# EasyEDA Pro project hardware.eprj, schematic Schematic7 (continued)
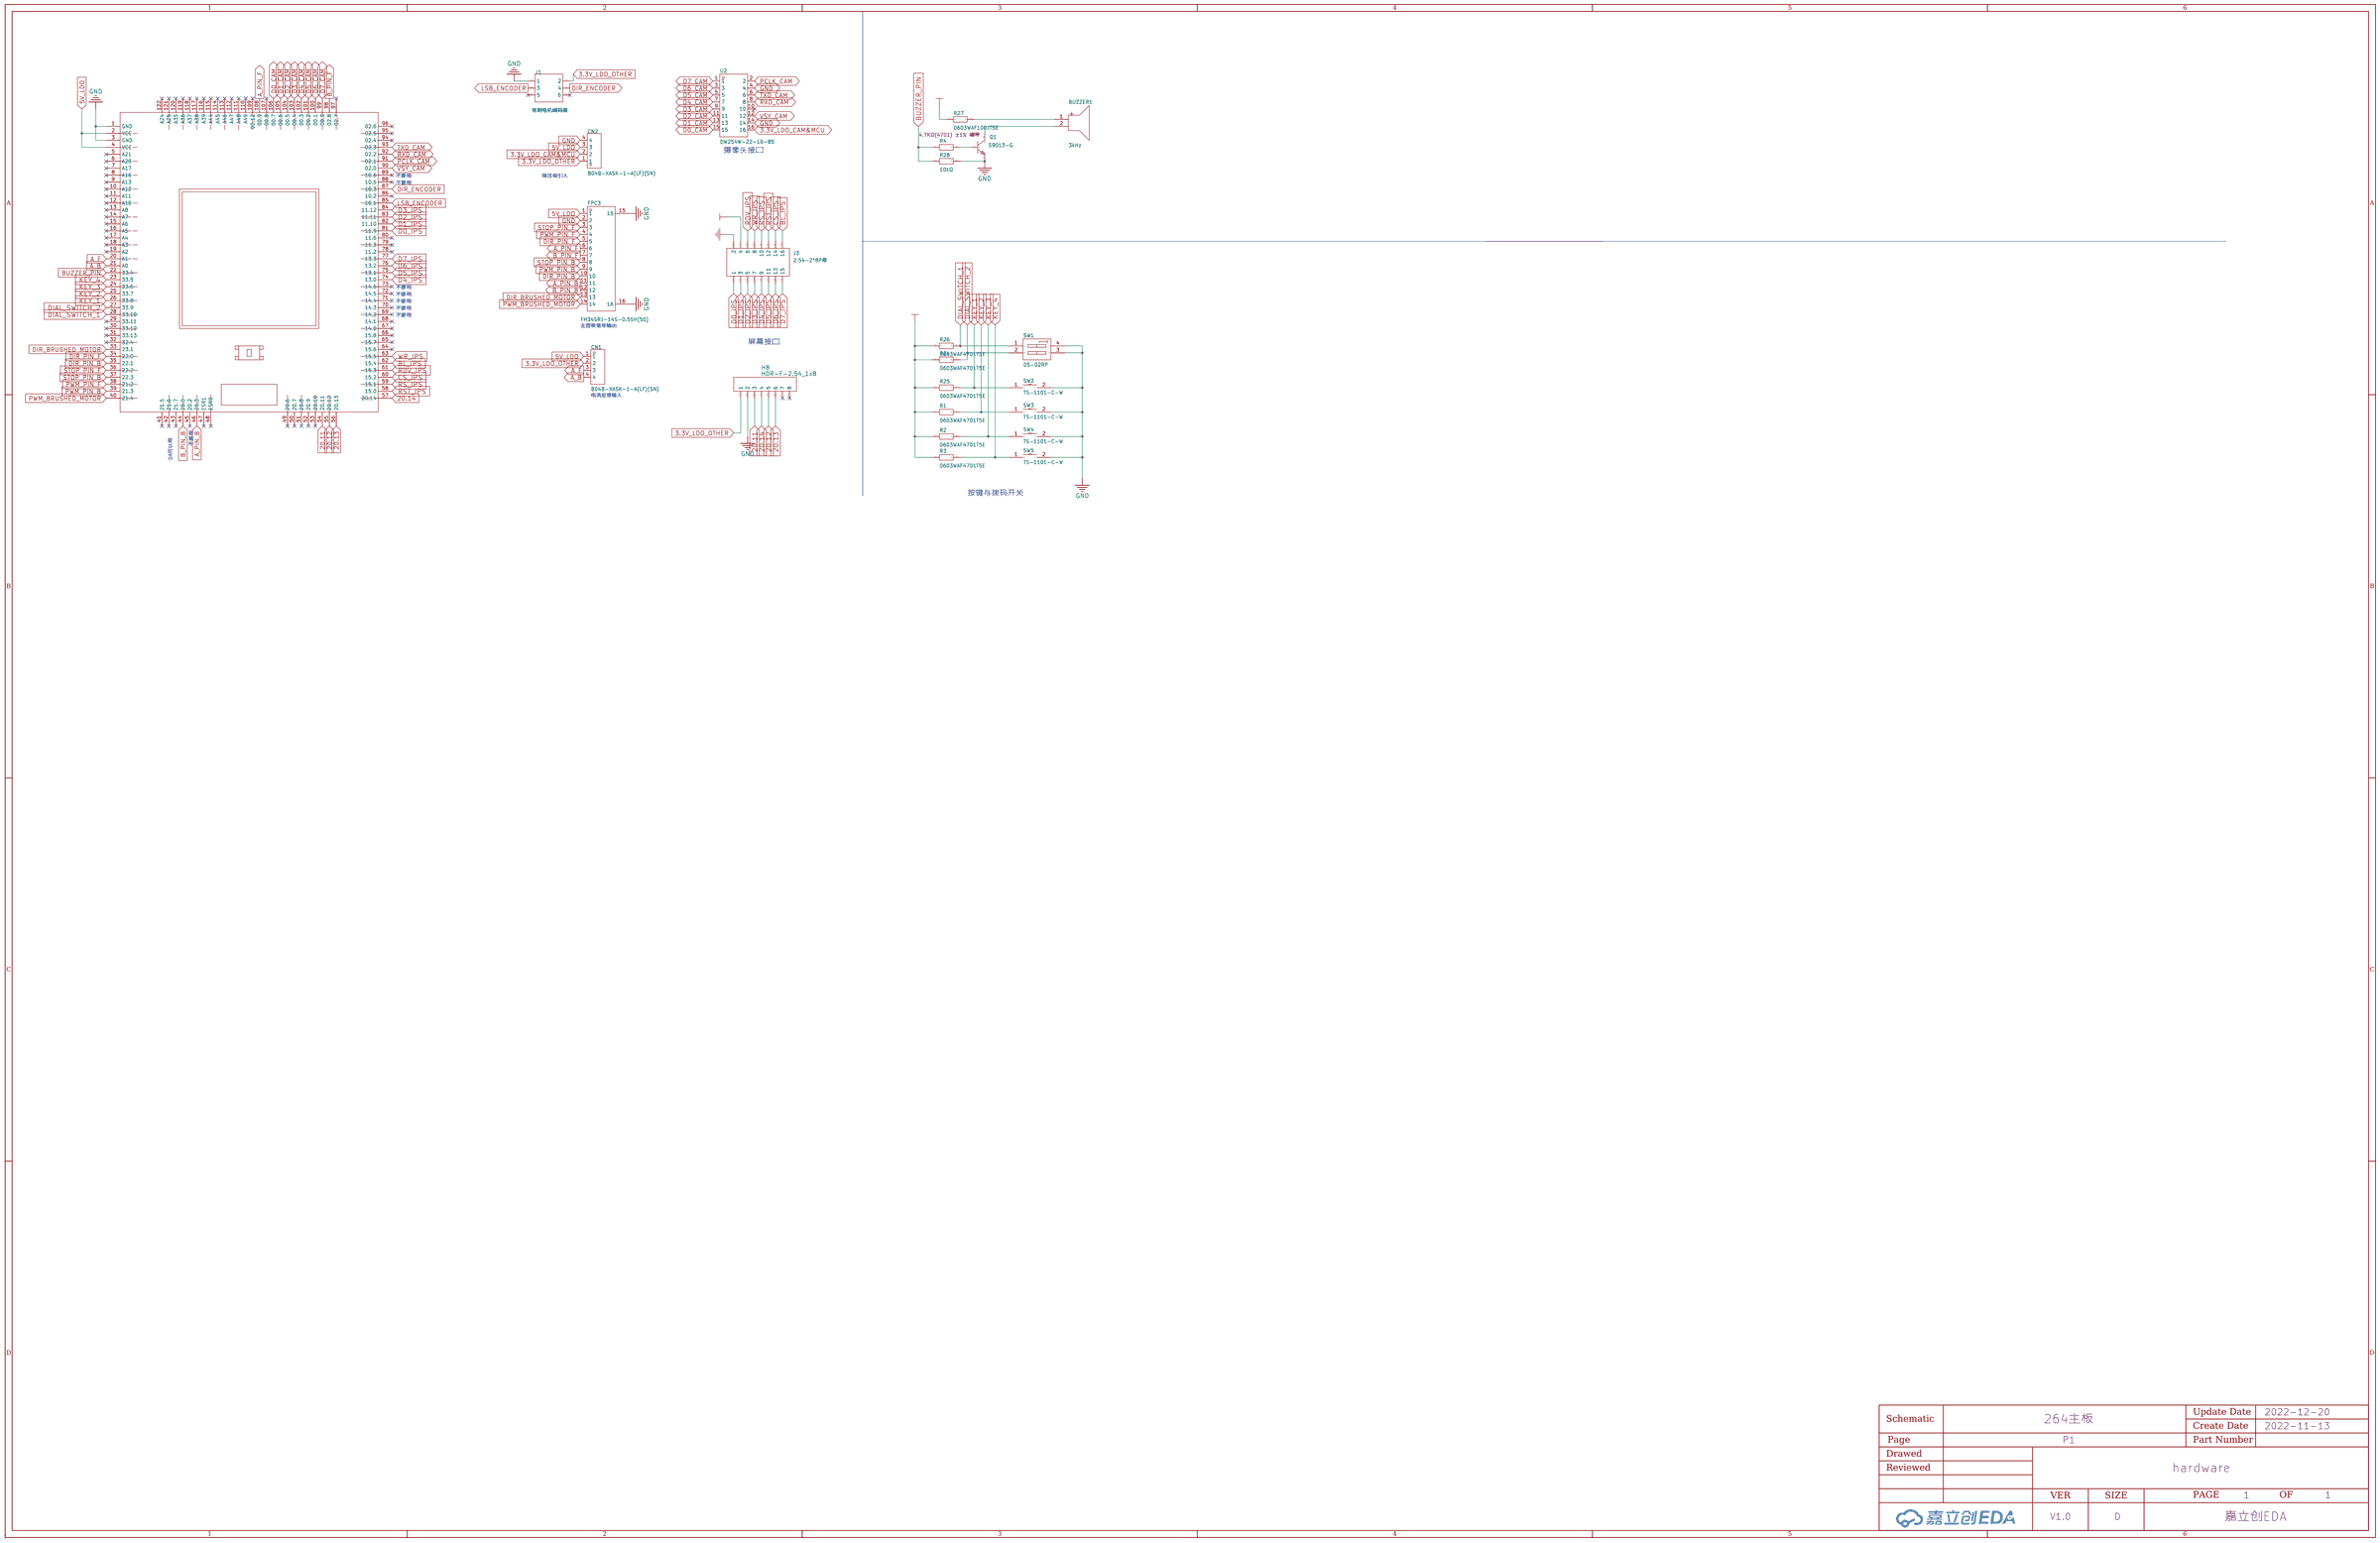
[diagram p0: schematic sheet]
## Library data of the parts (continued)
R12 R57 R59 R61 = 0603WAF1201T5E: LCSC Part Name: 1.2KΩ(1201) ±1% 编带; Supplier Part: C22765; Manufacturer: UNI-ROYAL(厚声); Supplier Footprint: 0603; JLCPCB Part Class: Basic Part; Datasheet: https://atta.szlcsc.com/upload/public/pdf/source/20170920/C22765_1505887453653980563.pdf; Supplier: LCSC
R13 = RC0603FR-07100RL: 电阻类型:厚膜电阻;阻值:100Ω;精度:±1%;功率:100mW;温度系数:±100ppm/℃;最大工作电压:75V;工作温度范围:-55℃~+155℃;; LCSC Part Name: 100Ω ±1%; Supplier Part: C105588; Manufacturer: YAGEO(国巨); Supplier Footprint: 0603; JLCPCB Part Class: Extended Part; Datasheet: https://atta.szlcsc.com/upload/public/pdf/source/20170428/1493376742308.pdf; Supplier: LCSC; Type: 厚膜电阻; Tolerance: ±1%; Power(Watts): 100mW; Temperature Coefficient: ±100ppm/℃; Overload Voltage (Max): 75V; Operating Temperature Range: -55℃~+155℃
R14-R17 R25 R62 = 0603WAF4701T5E: LCSC Part Name: 4.7KΩ(4701) ±1% 编带; Supplier Part: C23162; Manufacturer: UNI-ROYAL(厚声); Supplier Footprint: 0603; JLCPCB Part Class: Basic Part; Datasheet: https://atta.szlcsc.com/upload/public/pdf/source/20170920/C23162_1505901109673982545.pdf; Supplier: LCSC
R18 R28 R47 R48 R55 R58 R60 = 0603WAF1002T5E: 电阻类型:厚膜电阻;阻值:10kΩ;精度:±1%;功率:100mW;温度系数:±100ppm/;最大工作电压:75V;工作温度范围:-55~+155;; LCSC Part Name: 10kΩ ±1% 100mW; Supplier Part: C25804; Manufacturer: UNI-ROYAL(厚声); Supplier Footprint: 0603; JLCPCB Part Class: Basic Part; Datasheet: https://atta.szlcsc.com/upload/public/pdf/source/20200306/C422600_1E6D84923E4A46A82E41ADD87F860B5C.pdf; Supplier: LCSC; Type: 厚膜电阻; Tolerance: ±1%; Power(Watts): 100mW; Temperature Coefficient: ±100ppm/; Overload Voltage (Max): 75V; Operating Temperature Range: -55~+155
R27 = 0603WAF100JT5E: LCSC Part Name: 10Ω(10R0) ±1% 编带; Supplier Part: C22859; Manufacturer: UNI-ROYAL(厚声); Supplier Footprint: 0603; JLCPCB Part Class: Basic Part; Datasheet: https://atta.szlcsc.com/upload/public/pdf/source/20170920/C22859_1505900954295982249.pdf; Supplier: LCSC
SW1 = TS-1101-C-W: 触点电流:50mA;额定电压(DC):12V;绝缘电阻:100mΩ;电路结构:单刀单掷;安装方式:立贴;按钮形状:矩形按钮;按钮/盖帽颜色:白色;带灯:无;作用力:260gf;机械寿命:50000;工作温度:-30℃~+85℃;开关长度:6mm;开关宽度:3.6mm;开关高度:2.5mm;带支架:否;; LCSC Part Name: TS-1101-C-W 一型3*6*2.5有白ZD b拉伸白色按键 卷装; Supplier Part: C318938; Manufacturer: XKB Connectivity(中国星坤); Supplier Footprint: SMD; JLCPCB Part Class: Extended Part; Datasheet: https://atta.szlcsc.com/upload/public/pdf/source/20200227/C318938_C2E53B1EEDE37D980A33616AC086DE53.pdf; Supplier: LCSC; Contact Current: 50mA; Voltage Rating (DC): 12V; Insulation Resistance: 100mΩ; Circuit: 单刀单掷; Mounting Style: 立贴; Actuator Style: 矩形按钮; Actuator/Cap Color: 白色; With Lamp: 无; Operating Force: 260gf; Mechanical Life: 50000; Operating Temperature: -30℃~+85℃; Switch Length: 6mm; Switch Width: 3.6mm; Switch Height: 2.5mm; Strike Gundam: 否
SW2-SW5 = TS-1101-C-W: 触点电流:50mA;额定电压(DC):12V;绝缘电阻:100mΩ;电路结构:单刀单掷;安装方式:立贴;按钮形状:矩形按钮;按钮/盖帽颜色:白色;带灯:无;作用力:260gf;机械寿命:50000;工作温度:-30~+85;开关长度:6mm;开关宽度:3.6mm;开关高度:2.5mm;带支架:否;; LCSC Part Name: TS-1101-C-W 一型3*6*2.5有白ZD b拉伸白色按键 卷装; Supplier Part: C318938; Manufacturer: XKB Connectivity(中国星坤); Supplier Footprint: SMD; JLCPCB Part Class: Extended Part; Datasheet: https://atta.szlcsc.com/upload/public/pdf/source/20200227/C318938_C2E53B1EEDE37D980A33616AC086DE53.pdf; Supplier: LCSC; Contact Current: 50mA; Voltage Rating (DC): 12V; Insulation Resistance: 100mΩ; Circuit: 单刀单掷; Mounting Style: 立贴; Actuator Style: 矩形按钮; Actuator/Cap Color: 白色; With Lamp: 无; Operating Force: 260gf; Mechanical Life: 50000; Operating Temperature: -30~+85; Switch Length: 6mm; Switch Width: 3.6mm; Switch Height: 2.5mm; Strike Gundam: 否
U1 = TC377TP96F300SAAKXUMA1: Supplier Part: C3232089; Manufacturer: Infineon(英飞凌); Supplier Footprint: PG-LFBGA-292-6; Datasheet: https://atta.szlcsc.comnull; Supplier: LCSC
U2 U3 = CBM160808U501T: 标称阻抗@测试频率:500Ω@100MHz;误差:±25%;直流电阻(RDC):180mΩ;额定电流:1.2A;电路数:1;; LCSC Part Name: 500Ω@100MHz ±25%; Supplier Part: C316451; Manufacturer: FH(风华); Supplier Footprint: 0603; JLCPCB Part Class: Extended Part; Datasheet: https://atta.szlcsc.com/upload/public/pdf/source/20181211/C316451_DBF3079B2B53D5C89DC535D7CFA82CCE.pdf; Supplier: LCSC; Impedance @ Frequency: 500Ω@100MHz; Tolerance: ±25%; DC Resistance: 180mΩ; Current Rating: 1.2A; Circuits: 1
U4 U20-U22 = RT9043GB: 输出类型:可调;输出极性:正;输出通道数:1;最大输入电压:5.5V;输出电压:1.2V~5V;压差:350mV@(400mA);输出电流:400mA;电源纹波抑制比(PRSS):67dB@(1kHz),56dB@(10kHz);; LCSC Part Name: Vin=5.5V Vout=1.2V~5V 400mA 67dB@(1kHz),56dB@(10kHz); Supplier Part: C55019; Manufacturer: RICHTEK(台湾立锜); Supplier Footprint: SOT-23-5; JLCPCB Part Class: Extended Part; Datasheet: https://atta.szlcsc.com/upload/public/pdf/source/20150811/1457707342352.pdf; Supplier: LCSC; Output Type: 可调; Output Polarity: 正; Number of Outputs: 1; Maximum Input Voltage: 5.5V; Output Voltage: 1.2V~5V; Dropout Voltage: 350mV@(400mA); Output Current: 400mA; Power Supply Rejection Ratio (PRSS): 67dB@(1kHz),56dB@(10kHz)
U6 = PM254-1-08-W-8.5: 间距:2.54mm;总孔位数:8;排数:1;插孔结构:1x8P;行距:-;安装类型:弯插;圆孔/方孔:方孔;额定电流:3A;额定电压:-;插孔方向:侧面;塑高:8.5mm;工作温度范围:-40℃~+105℃;; LCSC Part Name: 2.54mm 1x8P; Supplier Part: C2897390; Manufacturer: HCTL(华灿天禄); Supplier Footprint: 弯插,P=2.54mm; JLCPCB Part Class: Extended Part; Datasheet: https://atta.szlcsc.com/upload/public/pdf/source/20211019/10E5F374A8C70BEE256048F5DCDE14A3.pdf; Supplier: LCSC; Pitch: 2.54mm; Number of Holes: 8; Number of Rows: 1; Holes Structure: 1x8P; Mounting Type: 弯插; Circular Hole / Square Hole: 方孔; Current Rating (Max): 3A; Holes Direction: 侧面; Insulation Height: 8.5mm; Operating Temperature Range: -40℃~+105℃
X1 = X322520MSB4SI: 晶振类型:贴片无源晶振;频率:20MHz;频率公差:±10ppm;频率稳定度:±30ppm;负载电容:20pF;工作温度:-40℃~+85℃;; LCSC Part Name: YSX321SL 20MHz ±10ppm 20pF; Supplier Part: C9004; Manufacturer: YXC(扬兴晶振); Supplier Footprint: SMD3225-4P; JLCPCB Part Class: Extended Part; Datasheet: https://atta.szlcsc.com/upload/public/pdf/source/20210329/C112971_1F611BDC486E193C1706F6D8EB5AA189.pdf; Supplier: LCSC; Crystal Type: 贴片无源晶振; Frequency Tolerance: ±10ppm; Frequency Stability: ±30ppm; Load Capacitance: 20pF; Operating Temperature: -40℃~+85℃
C56 C65 C66 = CL31A106KBHNNNE: 容值:10uF;精度:±10%;额定电压:50V;材质(温度系数):X5R;; LCSC Part Name: 10uF ±10% 50V; Supplier Part: C13585; Manufacturer: SAMSUNG(三星); Supplier Footprint: 1206; JLCPCB Part Class: Basic Part; Datasheet: https://atta.szlcsc.com/upload/public/pdf/source/20160103/1457707668742.pdf; Supplier: LCSC; Tolerance: ±10%; Voltage Rated: 50V; Temperature Coefficient: X5R
C57 C59 C70 = CC0603KRX7R9BB104: 容值:100nF;精度:±10%;额定电压:50V;材质(温度系数):X7R;; LCSC Part Name: 100nF ±10% 50V; Supplier Part: C14663; Manufacturer: YAGEO(国巨); Supplier Footprint: 0603; JLCPCB Part Class: Basic Part; Datasheet: https://atta.szlcsc.com/upload/public/pdf/source/20170116/1484561234239.pdf; Supplier: LCSC; Tolerance: ±10%; Voltage Rated: 50V; Temperature Coefficient: X7R
C58 C60 C61 = CL10A105KB8NNNC: 温度系数:X5R;精度:±10%;额定电压:50V;容值:1uF;; LCSC Part Name: 1uF(105) ±10% 50V; Supplier Part: C15849; Manufacturer: SAMSUNG(三星); Supplier Footprint: 0603; JLCPCB Part Class: Basic Part; Datasheet: https://atta.szlcsc.com/upload/public/pdf/source/20160103/1457707679084.pdf; Supplier: LCSC; Temperature Coefficient: X5R; Tolerance: ±10%; Voltage Rated: 50V
C62 = KM227M050G13RR0VH2FP0: 容值:220uF;脚间距:5mm;纹波电流:-;额定电压:50V;等效串联电阻:-;精度:±20%;工作寿命:2000hrs 105;电容体直径:10mm;工作温度:-;电容体长度:13mm;; LCSC Part Name: 220uF 50V; Supplier Part: C45105; Manufacturer: CX(承兴); Supplier Footprint: 径向引线,10x13mm; JLCPCB Part Class: Extended Part; Datasheet: https://atta.szlcsc.com/upload/public/pdf/source/20151029/1457707529682.pdf; Supplier: LCSC; Lead Spacing: 5mm; Rated Voltage: 50V; Tolerance: ±20%; Lifetime @ Temp: 2000hrs 105; φD: 10mm; L: 13mm
C67 = CC0603KRX7R9BB822: 容值:8.2nF;精度:±10%;额定电压:50V;材质(温度系数):X7R;; LCSC Part Name: 8.2nF ±10% 50V; Supplier Part: C113812; Manufacturer: YAGEO(国巨); Supplier Footprint: 0603; JLCPCB Part Class: Extended Part; Datasheet: https://atta.szlcsc.com/upload/public/pdf/source/20170602/1496384445452.pdf; Supplier: LCSC; Tolerance: ±10%; Voltage Rated: 50V; Temperature Coefficient: X7R
C68 = CC0402JRNPO9BN100: 容值:10pF;精度:±5%;额定电压:50V;材质(温度系数):NP0;; LCSC Part Name: 10pF ±5% 50V; Supplier Part: C106199; Manufacturer: YAGEO(国巨); Supplier Footprint: 0402; JLCPCB Part Class: Extended Part; Datasheet: https://atta.szlcsc.com/upload/public/pdf/source/20170518/1495085708228.pdf; Supplier: LCSC; Tolerance: ±5%; Voltage Rated: 50V; Temperature Coefficient: NP0
C69 = CC0603KRX7R9BB102: 容值:1nF;精度:±10%;额定电压:50V;材质(温度系数):X7R;; LCSC Part Name: 1nF ±10% 50V; Supplier Part: C100040; Manufacturer: YAGEO(国巨); Supplier Footprint: 0603; JLCPCB Part Class: Extended Part; Datasheet: https://atta.szlcsc.com/upload/public/pdf/source/20170420/1492670664651.pdf; Supplier: LCSC; Tolerance: ±10%; Voltage Rated: 50V; Temperature Coefficient: X7R
C71 C72 = GRM31CR61A476ME15L: 容值:47uF;精度:±20%;额定电压:10V;温度系数:X5R;; LCSC Part Name: 47uF 10V; Supplier Part: C94034; Manufacturer: muRata(村田); Supplier Footprint: 1206; JLCPCB Part Class: Extended Part; Datasheet: https://atta.szlcsc.com/upload/public/pdf/source/20170310/1489116302849.pdf; Supplier: LCSC; Tolerance: ±20%; Voltage Rated: 10V; Temperature Coefficient: X5R
C80 = CC0603KRX7R9BB103: 容值:10nF;精度:±10%;额定电压:50V;材质(温度系数):X7R;; LCSC Part Name: 10nF ±10% 50V; Supplier Part: C100042; Manufacturer: YAGEO(国巨); Supplier Footprint: 0603; JLCPCB Part Class: Extended Part; Datasheet: https://atta.szlcsc.com/upload/public/pdf/source/20180326/C100042_E8B0111D51DE3671A0A4A59FBCEFE81C.pdf; Supplier: LCSC; Tolerance: ±10%; Voltage Rated: 50V; Temperature Coefficient: X7R
CN2 = XT60PW-M: 模型锂电连接器; LCSC Part Name: XT60PW 公头 板插卧式; Supplier Part: C98732; Manufacturer: AMASS(艾迈斯); Supplier Footprint: Through Hole; JLCPCB Part Class: Extended Part; Datasheet: https://atta.szlcsc.com/upload/public/pdf/source/20180125/C98732_15168617837851301983.pdf; Supplier: LCSC
CN7 = XT30PW-M: Socket,DCsupply,XT30,male,PIN:2; LCSC Part Name: XT30PW-M公头; Supplier Part: C431092; Manufacturer: AMASS(艾迈斯); Supplier Footprint: Through Hole; JLCPCB Part Class: Extended Part; Datasheet: https://atta.szlcsc.com/upload/public/pdf/source/20220222/6A9F22F7850E25B33E1BE430ADF8560B.pdf; Supplier: LCSC
CN8 CN9 = HC-ZH1.5-8AW: 参考系列:ZH;间距:1.5mm;插针结构:1x8P;排数:1;每排PIN数:8;行距:-;公母:公型插针;安装方式:弯插;额定电流:1A;工作温度范围:-25~+85;; LCSC Part Name: 8P 间距P=1.5mm; Supplier Part: C2845571; Manufacturer: HCTL(华灿天禄); Supplier Footprint: 插件,P=1.5mm; JLCPCB Part Class: Extended Part; Datasheet: https://atta.szlcsc.com/upload/public/pdf/source/20211122/624702E7E83328BF37B6C704FA01E49F.pdf; Supplier: LCSC; Reference Series: ZH; Pitch: 1.5mm; Pins Structure: 1x8P; Number of Rows: 1; Number of PINs Per Row: 8; Gender: 公型插针; Mounting Style: 弯插; Current Rating (Max): 1A; Operating Temperature Range: -25~+85
D2 = SS34_C8678: 40V,3A,VF=0.55V 3A; Supplier Part: C8678; Manufacturer: MDD; Supplier Footprint: SMA(DO-214AC); JLCPCB Part Class: Basic Part; Datasheet: https://atta.szlcsc.com/upload/public/pdf/source/20220408/D0396E57A6E83C6AFC0ED25EC9EDE030.pdf; Supplier: LCSC
D3 = SS54C_C908244: 二极管配置:独立式;直流反向耐压(Vr):40V;平均整流电流(Io):5A;正向压降(Vf):550mV@5A;反向电流(Ir):500uA@40V;; LCSC Part Name: 40V 5A 550mV@5A; Supplier Part: C908244; Manufacturer: FUXINSEMI(富芯森美); Supplier Footprint: SMC(DO-214AB); JLCPCB Part Class: Extended Part; Datasheet: https://atta.szlcsc.com/upload/public/pdf/source/20201027/C908242_77C8A81B3EBE52B4332ED1F80CC85D97.pdf; Supplier: LCSC; Diode Configuration: 独立式; Reverse Voltage (Vr): 40V; Average Rectified Current (Io): 5A; Forward Voltage (Vf@If): 550mV@5A; Reverse Leakage Current (Ir): 500uA@40V
L3 = MWSA1004S-100MT: 精度:±20%;直流电阻(DCR):30mΩ;额定电流:7.8A;电感值:10uH;; LCSC Part Name: 10uH ±20%; Supplier Part: C408487; Manufacturer: Sunlord(顺络); Supplier Footprint: SMD; JLCPCB Part Class: Extended Part; Datasheet: https://atta.szlcsc.com/upload/public/pdf/source/20190729/C408487_10B27C975B2F63C7424A4B34DD502902.pdf; Supplier: LCSC; Tolerance: ±20%; DC Resistance (DCR): 30mΩ; Height: 4mm; Rated Current: 7.8A; Width: 11.5mm; Length: 10mm
LED9-LED11 = 19-217/GHC-YR1S2/3T: 照明颜色:翠绿;色温 - CCT（K）:-;主波长/色坐标:520~535nm;; LCSC Part Name: 翠绿LED; Supplier Part: C72043; Manufacturer: EVERLIGHT(台湾亿光); Supplier Footprint: 0603; JLCPCB Part Class: Basic Part; Datasheet: https://atta.szlcsc.com/upload/public/pdf/source/20160507/1462613613780.pdf; Supplier: LCSC; Mounting Type: 表面贴装; Illumination Color: 翠绿; Luminous Intensity (IF=20mA): 112~258mcd; Dominant Wavelength / Coordinate rank: 520~535nm
Q7-Q10 = TPH1R403NL,L1Q(M: Supplier Part: C2940403; Manufacturer: TOSHIBA(东芝); Supplier Footprint: SOP-8; Datasheet: https://atta.szlcsc.com/upload/public/pdf/source/20220830/C277A7BCA37DB7348B2C95BA2E6DA6BE.pdf; Supplier: LCSC
R11 R19-R21 R46 = 0603WAF0000T5E: 温度系数:-;精度:±1%;阻值:0Ω;功率:1/10W;最大工作电压:75V;工作温度范围:-55~+155;; LCSC Part Name: 0Ω ±1%; Supplier Part: C21189; Manufacturer: UNI-ROYAL(厚声); Supplier Footprint: 0603; JLCPCB Part Class: Basic Part; Datasheet: https://atta.szlcsc.com/upload/public/pdf/source/20170920/C21189_1505887441435980537.pdf; Supplier: LCSC; Tolerance: ±1%; Power(Watts): 1/10W; Overload Voltage (Max): 75V; Operating Temperature Range: -55~+155
R52 = 0603WAF6812T5E: LCSC Part Name: 68.1KΩ(6812) ±1% 编带; Supplier Part: C25976; Manufacturer: UNI-ROYAL(厚声); Supplier Footprint: 0603; JLCPCB Part Class: Extended Part; Datasheet: https://atta.szlcsc.com/upload/public/pdf/source/20170920/C25976_1505895134985980970.pdf; Supplier: LCSC
R53 = 0603WAF1022T5E: 电阻类型:厚膜电阻;阻值:10.2kΩ;精度:±1%;功率:100mW;温度系数:±100ppm/;最大工作电压:75V;工作温度范围:-55~+155;; LCSC Part Name: 10.2kΩ ±1% 100mW; Supplier Part: C22772; Manufacturer: UNI-ROYAL(厚声); Supplier Footprint: 0603; JLCPCB Part Class: Extended Part; Datasheet: https://atta.szlcsc.com/upload/public/pdf/source/20200306/C422600_1E6D84923E4A46A82E41ADD87F860B5C.pdf; Supplier: LCSC; Type: 厚膜电阻; Tolerance: ±1%; Power(Watts): 100mW; Temperature Coefficient: ±100ppm/; Overload Voltage (Max): 75V; Operating Temperature Range: -55~+155
R54 = 0603WAF1741T5E: 电阻类型:厚膜电阻;阻值:1.74kΩ;精度:±1%;功率:1/10W;温度系数:±100ppm/;最大工作电压:75V;工作温度范围:-55~+155;; LCSC Part Name: 1.74kΩ ±1%; Supplier Part: C22848; Manufacturer: UNI-ROYAL(厚声); Supplier Footprint: 0603; JLCPCB Part Class: Extended Part; Datasheet: https://atta.szlcsc.com/upload/public/pdf/source/20200306/C422600_1E6D84923E4A46A82E41ADD87F860B5C.pdf; Supplier: LCSC; Type: 厚膜电阻; Tolerance: ±1%; Power(Watts): 1/10W; Temperature Coefficient: ±100ppm/; Overload Voltage (Max): 75V; Operating Temperature Range: -55~+155
R56 = 0603WAF3831T5E: 精度:±1%;温度系数:±100ppm/;功率:1/10W;阻值:3.83kΩ;最大工作电压:75V;工作温度范围:-55~+155;; LCSC Part Name: 3.83KΩ ±1%; Supplier Part: C22982; Manufacturer: UNI-ROYAL(厚声); Supplier Footprint: 0603; JLCPCB Part Class: Extended Part; Datasheet: https://atta.szlcsc.com/upload/public/pdf/source/20170920/C22982_1505901016435982369.pdf; Supplier: LCSC; Tolerance: ±1%; Temperature Coefficient: ±100ppm/; Power(Watts): 1/10W; Overload Voltage (Max): 75V; Operating Temperature Range: -55~+155
R63 R64 = 0603WAF2701T5E: 电阻类型:厚膜电阻;阻值:2.7kΩ;精度:±1%;功率:100mW;温度系数:±100ppm/;最大工作电压:75V;工作温度范围:-55~+155;; LCSC Part Name: 2.7kΩ ±1% 100mW; Supplier Part: C13167; Manufacturer: UNI-ROYAL(厚声); Supplier Footprint: 0603; JLCPCB Part Class: Basic Part; Datasheet: https://atta.szlcsc.com/upload/public/pdf/source/20200306/C422600_1E6D84923E4A46A82E41ADD87F860B5C.pdf; Supplier: LCSC; Type: 厚膜电阻; Tolerance: ±1%; Power(Watts): 100mW; Temperature Coefficient: ±100ppm/; Overload Voltage (Max): 75V; Operating Temperature Range: -55~+155
R65 R66 = 0603WAF2101T5E: 电阻类型:厚膜电阻;阻值:2.1kΩ;精度:±1%;功率:100mW;温度系数:±100ppm/;最大工作电压:75V;工作温度范围:-55~+155;; LCSC Part Name: 2.1kΩ ±1% 100mW; Supplier Part: C22902; Manufacturer: UNI-ROYAL(厚声); Supplier Footprint: 0603; JLCPCB Part Class: Extended Part; Datasheet: https://atta.szlcsc.com/upload/public/pdf/source/20200306/C422600_1E6D84923E4A46A82E41ADD87F860B5C.pdf; Supplier: LCSC; Type: 厚膜电阻; Tolerance: ±1%; Power(Watts): 100mW; Temperature Coefficient: ±100ppm/; Overload Voltage (Max): 75V; Operating Temperature Range: -55~+155
SW8 = MT-0-103-A101-M200-RS+PJ: 额定电流:5A;额定电压(AC):125V;电路结构:单刀双掷;钮柄形状:圆柱钮柄;引脚样式:焊片;安装方式:直插;工作温度:-25~+85;开关长度:13mm;开关宽度:8mm;开关高度:28.6mm;; LCSC Part Name: 小型钮子三脚三档(五件套); Supplier Part: C1788493; Manufacturer: YUEN FUNG(源丰); Supplier Footprint: 插件; JLCPCB Part Class: Extended Part; Datasheet: https://atta.szlcsc.com/upload/public/pdf/source/20201225/C1788493_608759AD4D4A20FF90A03E3E3321FD91.pdf; Supplier: LCSC; Contact Current: 5A; Voltage Rating (AC): 125V; Circuit: 单刀双掷; Actuator Type: 圆柱钮柄; Pin Style: 焊片; Mounting Style: 直插; Operating Temperature: -25~+85; Switch Length: 13mm; Switch Width: 8mm; Switch Height: 28.6mm
U7 U24 = CC6902SO-5A: 单芯片霍尔电流传感器5A/10A/20A/30A系列,隔离耐压2kV,增益400mV/A; Supplier Part: C465515; Manufacturer: CrossChip(成都芯进); Supplier Footprint: SOP-8-150mil; JLCPCB Part Class: Extended Part; Datasheet: https://atta.szlcsc.com/upload/public/pdf/source/20210401/C350865_A3325EEAFF04FA6E122338C4D9E855FE.pdf; Supplier: LCSC
U16 = DRV8701ERGET: DRV8701 DRV8701 H 桥栅极驱动器; Supplier Part: C132049; Manufacturer: TI(德州仪器); Supplier Footprint: VQFN-24; JLCPCB Part Class: Extended Part; Datasheet: https://atta.szlcsc.com/upload/public/pdf/source/20170925/C132049_1506321643935990409.pdf; Supplier: LCSC
U17 = SN74HC125PWR: 逻辑电路的归属系列:74HC;逻辑类型:缓冲器，非反向;元件数:4;每元件位数:1;; Supplier Part: C132994; Manufacturer: TI(德州仪器); Supplier Footprint: TSSOP-14; JLCPCB Part Class: Extended Part; Datasheet: https://atta.szlcsc.com/upload/public/pdf/source/20170930/C132994_1506736365150997346.pdf; Supplier: LCSC; Series: 74HC; Logic Type: 缓冲器，非反向; Number of Elements: 4; Number of Bits per Element: 1; Output Type: 三态; Current - Output High, Low: 7.8mA、7.8mA; Voltage - Supply: 2V ~ 6V; Operating Temperature: -40~+85（TA）
U19 = TPS54331DDAR: 功能类型:降压型;同步整流:-;输出通道数:-;拓扑结构:-;输入电压:-;输出电流(最大值):-;开关频率:-;; LCSC Part Name: 降压型; Supplier Part: C90761; Manufacturer: TI(德州仪器); Supplier Footprint: SOIC-8-EP-150mil; JLCPCB Part Class: Extended Part; Datasheet: https://atta.szlcsc.com/upload/public/pdf/source/20171221/C90761_15138313277351195613.pdf; Supplier: LCSC; Function: 降压型

## Nets
1.3V: C1.2 C2.2 C3.2 C4.2 C5.2 C6.2 C7.2 C8.2 C20.2 C21.2 C22.2 C27.1 C81.2 R13.2 U1.D16(VDD) U1.E15(VDD) U1.G8(VDDSB(VDD)) U1.G13(VDD) U1.H7(VDDSB(VDD)) U1.H14(VDD) U1.N7(VDD) U1.N14(VDD) U1.N19(VDD) U1.P8(VDD) U1.P13(VDD) U4.5(VOUT)
3.3V_LDO_CAM&MCU: C10.2 C11.2 C12.2 C13.2 C14.2 C15.2 C16.2 C17.2 C18.2 C19.2 C28.1 C75.1 FPC1.17 FPC1.18 R6.1 R18.1 R63.2 R66.2 U1.A2(VEXT) U1.A19(VDDP3) U1.B3(VEXT) U1.B18(VDDP3) U1.D5(VFLEX) U1.N20(VEXT) U1.T11(VEVRSB) U1.V19(VFLEX2) U1.W20(VEXT) U4.1(VIN) U21.5(VOUT)
3.3V_LDO_OTHER: C77.1 H1.1 J1.2 J3.4 LED2.2(A) LED3.2(A) Q1.2(E) R1.2 R14.1 R15.1 R16.1 R25.1 R27.1 R64.2 R65.2 U6.1 U7.8(VCC) U16.13(nSLEEP) U22.5(VOUT) U24.8(VCC)
5.5V_DCDC: C71.2 C72.2 C74.1 C76.1 C78.1 L3.2 R53.2 R55.1 R58.1 R60.1 U20.1(VIN) U21.1(VIN) U22.1(VIN)
5V_LDO: C73.1 CN8.6 CN9.6 H3.7 R56.2 R62.2 U2.1 U20.5(VOUT)
DVDD: C61.2 U16.8(DVDD) U17.14(VCC)
GND: C56.1 C57.2 C60.1 C61.1 C62.2 C65.1 C66.1 C67.1 C68.1 C69.1 C71.1 C72.1 C73.2 C74.2 C75.2 C76.2 C77.2 C78.2 C80.1 CN2.1(-) CN8.2 CN9.2 D3.1(A) LED9.2(C) LED10.2(C) LED11.2(C) R11.2 R19.2 R20.2 R21.2 R46.1 R47.1 R48.1 R54.1 R57.1 R59.1 R61.1 U7.5(GND) U16.5(GND) U16.16(GND) U16.25(EP) U17.1(1OE#) U17.4(2OE#) U17.7(GND) U17.10(3OE#) U17.13(4OE#) U19.7(GND) U19.9(EP) U20.2(GND) U21.2(GND) U22.2(GND) U24.5(GND)
GND_CORE: C1.1 C2.1 C3.1 C4.1 C5.1 C6.1 C7.1 C8.1 C10.1 C11.1 C12.1 C13.1 C14.1 C15.1 C16.1 C17.1 C18.1 C19.1 C20.1 C21.1 C22.1 C23.1 C27.2 C28.2 C81.1 FPC1.2 FPC1.7 FPC1.16 FPC1.19 FPC1.20 H1.3 H1.5 H3.5 H3.6 J1.1 J3.2 Q2.2(E) R3.2 R11.1 R12.1 R19.1 R20.1 R21.1 R28.2 SW1.1 SW2.2 SW3.2 SW4.2 SW5.2 U1.A20(VSS) U1.B2(VSS) U1.B19(VSS) U1.D4(VSS) U1.D17(VSS) U1.E5(VSS) U1.E16(VSS) U1.G9(VSS) U1.G12(VSS) U1.H9(VSS) U1.H10(VSS) U1.H11(VSS) U1.H12(VSS) U1.J7(VSS) U1.J8(VSS) U1.J10(VSS) U1.J11(VSS) U1.J13(VSS) U1.J14(VSS) U1.K7(AGBTCLKP(VSS)) U1.K8(VSS) U1.K9(VSS) U1.K10(VSS) U1.K11(VSS) U1.K12(VSS) U1.K13(VSS) U1.L7(AGBTCLKN(VSS)) U1.L8(VSS) U1.L9(VSS) U1.L10(VSS) U1.L11(VSS) U1.L12(VSS) U1.L13(VSS) U1.L14(AGBTERR(VSS)) U1.L20(VSS) U1.M7(VSS) U1.M8(VSS) U1.M10(VSS) U1.M11(VSS) U1.M13(VSS) U1.M14(VSS) U1.N9(VSS) U1.N10(VSS) U1.N11(VSS) U1.N12(VSS) U1.P9(VSS) U1.P10(AGBTTXN(VSS)) U1.P11(AGBTTXP(VSS)) U1.P12(VSS) U1.T16(VSS) U1.U17(VSS) U1.W19(VSS) U1.Y20(VSS) U3.2 U4.2(GND) U6.2 X1.2(GND) X1.4(GND)
VCC_BAT: C62.1 C65.2 C66.2 C80.2 D2.2(A) Q7.5(D) Q7.6(D) Q7.7(D) Q7.8(D) Q7.9(D) Q9.5(D) Q9.6(D) Q9.7(D) Q9.8(D) Q9.9(D) SW8.2 SW8.3 U7.1(IP+) U7.2(IP+) U19.2(VIN) U24.1(IP+) U24.2(IP+)
VCC_BAT_B: CN9.1 U24.3(IP-) U24.4(IP-)
VCC_BAT_F: CN8.1 U7.3(IP-) U7.4(IP-)
VDDM: C26.2 R7.2 R8.2
VSSM: C26.1 R9.2 R10.2
10.2: H3.4 U1.A5(P10.2)
10.5: H3.1 U1.B5(P10.5)
10.6: H3.3 U1.A4(P10.6)
A_B: U1.U10(AN1) U24.7(OUT)
A_BRUSHED_MOTOR: CN7.2 Q7.1(S) Q7.2(S) Q7.3(S) Q8.5(D) Q8.6(D) Q8.7(D) Q8.8(D) Q8.9(D) U16.23(SH2)
A_F: U1.T10(AN0) U7.7(OUT)
A_PIN_B: CN9.7 U1.G20(P20.3)
A_PIN_F: CN8.7 U1.K2(P00.9)
B_BRUSHED_MOTOR: CN7.1 Q9.1(S) Q9.2(S) Q9.3(S) Q10.5(D) Q10.6(D) Q10.7(D) Q10.8(D) Q10.9(D) U16.18(SH1)
B_PIN_B: CN9.8 U1.H20(P20.0)
B_PIN_F: CN8.8 U1.F1(P02.8)
BL_IPS: J3.16 U1.A17(P15.4)
BUZZER_PIN: R17.1 R28.1 U1.W12(P33.4)
CS_IMU: U1.D20(P20.13) U6.6
CS_IPS: J3.14 U1.C19(P15.2)
D0_CAM: FPC1.8 U1.K1(P00.7)
D0_IPS: J3.1 U1.A9(P11.9)
D1_CAM: FPC1.9 U1.J4(P00.6)
D1_IPS: J3.3 U1.B9(P11.10)
D2_CAM: FPC1.10 U1.J2(P00.5)
D2_IPS: J3.5 U1.A8(P11.11)
D3_CAM: FPC1.11 U1.J1(P00.4)
D3_IPS: J3.7 U1.B8(P11.12)
D4_CAM: FPC1.12 U1.H2(P00.3)
D4_IPS: J3.9 U1.B12(P13.0)
D5_CAM: FPC1.13 U1.H1(P00.2)
D5_IPS: J3.11 U1.A12(P13.1)
D6_CAM: FPC1.14 U1.G2(P00.1)
D6_IPS: J3.13 U1.B11(P13.2)
D7_CAM: FPC1.15 U1.G1(P00.0)
D7_IPS: J3.15 U1.A11(P13.3)
DIR_BRUSHED_MOTOR: R47.2 U1.U19(P23.1) U17.2(1A)
DIR_BRUSHED_MOTOR_OK: U16.15(PH) U17.3(1Y)
DIR_ENCODER: J1.4 U1.B7(P10.1)
DIR_PIN_B: CN9.5 U1.L17(P22.1)
DIR_PIN_F: CN8.5 U1.L16(P22.0)
KEY_1: R25.2 SW2.1 U1.W14(P33.8)
KEY_2: R14.2 SW3.1 U1.Y13(P33.7)
KEY_3: R15.2 SW4.1 U1.W13(P33.6)
KEY_4: R16.2 SW5.1 U1.Y12(P33.5)
LSB_ENCODER: J1.3 U1.A6(P10.3)
P02.5: R5.2 U1.E2(P02.5)
P02.6: R4.2 U1.E1(P02.6)
P14.0: H1.7 U1.B16(P14.0)
P14.1: H1.9 U1.A15(P14.1)
P21.7: H1.6 U1.H16(P21.7/TDO)
PCLK_CAM: FPC1.1 U1.C2(P02.1)
PWM_BRUSHED_MOTOR: R48.2 U1.K20(P21.4) U17.5(2A)
PWM_BRUSHED_MOTOR_OK: U16.14(EN) U17.6(2Y)
PWM_PIN_B: CN9.4 U1.J19(P21.3)
PWM_PIN_F: CN8.4 U1.K19(P21.2)
RDV_IPS: J3.6 U1.B17(P15.3)
RS_IPS: J3.10 U1.A18(P15.1)
RST: F1.2 H1.10 U1.G17(PORST#)
RST_IPS: J3.12 U1.B20(P15.0)
RXD_CAM: FPC1.4 U1.C1(P02.2)
SDI_IMU: U1.C20(P20.14) U6.4
SDO_IMU: U1.D19(P20.12) U6.5
SPC_IMU: U1.E20(P20.11) U6.3
STOP_PIN_B: CN9.3 U1.R19(P22.3)
STOP_PIN_F: CN8.3 U1.R20(P22.2)
TCK: H1.4 U1.J16(TCK)
TMS: H1.2 U1.K16(TMS)
TRST: H1.8 R6.2 U1.L19(TRST#)
TXD_CAM: FPC1.3 U1.D2(P02.3)
VAGND1: C25.1 R10.1 U1.Y7(VAGND1)
VAGND2: C24.1 R9.1 U1.T2(VAGND2)
VAREF1: C25.2 R8.1 U1.Y6(VAREF1)
VAREF2: C24.2 R7.1 U1.T1(VAREF2)
VSY_CAM: FPC1.6 U1.B1(P02.0)
WR_IPS: J3.8 U1.E14(P15.5)
$1N10211: U1.Y5(VDDM) U2.2
$1N10216: U1.Y4(VSSM) U3.1
$1N10225: C23.2 F1.1 R1.1 SW1.2
$1N10227: R2.2 U1.F16(ESR0#)
$1N10228: Q1.1(B) R2.1
$1N10230: LED1.2(A) Q1.3(C)
$1N10231: LED1.1(K) R3.1
$1N10234: LED2.1(K) R4.1
$1N10235: LED3.1(K) R5.1
$1N10265: U1.M19(XTAL2) X1.3(OSC2)
$1N10268: U1.M20(XTAL1) X1.1(OSC1)
$1N10337: R18.2 U4.3(EN)
$1N10343: R12.2 R13.1 U4.4(FB)
$1N10406: Q2.1(B) R17.2
$1N10408: BUZZER1.1(+) R27.2
$1N10409: BUZZER1.2(-) Q2.3(C)
$2N5546: C58.1 U16.2(VCP)
$2N5547: C56.2 C57.1 C58.2 D2.1(K) U16.1(VM)
$2N5548: C59.2 U16.3(CPH)
$2N5549: C59.1 U16.4(CPL)
$2N5550: C60.2 U16.6(VREF) U16.7(AVDD) U16.12(IDRIVE)
$2N5554: Q7.4(G) U16.24(GH2)
$2N5555: Q8.4(G) U16.22(GL2)
$2N5557: Q10.4(G) U16.19(GL1)
$2N5558: Q9.4(G) U16.17(GH1)
$2N5585: C67.2 U19.4(SS)
$2N5586: C68.2 R52.2 U19.6(COMP)
$2N5587: C69.2 R52.1
$2N5589: R53.1 R54.2 U19.5(VSENSE)
$2N5592: R55.2 U20.3(EN)
$2N5593: R56.1 R57.2 U20.4(FB)
$2N5596: R58.2 U21.3(EN)
$2N5597: R59.2 R66.1 U21.4(FB)
$2N5599: R61.2 R65.1 U22.4(FB)
$2N5600: R60.2 U22.3(EN)
$2N5613: LED11.1(A) R62.1
$2N5615: LED9.1(A) R63.1
$2N5617: LED10.1(A) R64.1
$2N5619: C70.2 D3.2(K) L3.1 U19.8(PH)
$2N5620: C70.1 U19.1(BOOT)
$2N5652: CN2.2(+) CN2.3 SW8.1
$2N5658: Q8.1(S) Q8.2(S) Q8.3(S) Q10.1(S) Q10.2(S) Q10.3(S) R46.2 U16.20(SN) U16.21(SP)

Not connected (* = marked no-connect by the designer): CN2 4*; CN7 3* 4*; FPC1 5*; H3 2* 8*; J1 5* 6*; U1 A1(NC1)* A3(P10.7)* A7(P10.0)* A10(P11.2)* A13(P14.8)* A14(P14.5)* A16(P15.6)* B4(P10.8)* B6(P10.4)* B10(P11.3)* B13(P14.6)* B14(P14.3)* B15(P14.4)* D1(P02.4)* D6(P11.15)* D7(P11.14)* D8(P11.5)* D9(P11.6)* D10(P11.4)* D11(P14.10)* D12(P14.9)* D13(P14.7)* D14(P15.8)* D15(P15.7)* E4(P02.9)* E6(P11.13)* E7(P11.8)* E8(P11.7)* E9(P11.1)* E10(P11.0)* E11(P12.1)* E12(P12.0)* E13(P14.2)* E17(P20.9)* E19(P20.10)* F2(P02.7)* F4(P02.11)* F5(P02.10)* F17(P20.6)* F19(P20.7)* F20(P20.8)* G4(P01.4)* G5(P01.3)* G10(DAPE2)* G11(DAPE1)* G16(ESR1#)* G19(P20.1)* H4(P01.6)* H5(P01.5)* H17(P21.6/)* H19(P20.2)* J5(P01.7)* J17(P21.1)* J20(P21.5)* K4(P00.8)* K5(P00.10)* K14(DAPE0)* K17(P21.0)* L1(P00.11)* L2(P00.12)* L4(AN43)* L5(AN42)* M1(AN46)* M2(AN47)* M4(AN41)* M5(AN40)* M16(P22.8)* M17(P22.9)* N1(AN44)* N2(AN45)* N4(AN36/P40.6)* N5(AN38/P40.8)* N16(P22.6)* N17(P22.7)* P1(AN39/P40.9)* P2(AN37/P40.7)* P4(AN32/P40.4)* P5(AN34)* P16(P22.4)* P17(P22.5)* P19(P22.11)* P20(P22.10)* R1(AN33/P40.5)* R2(AN35)* R4(AN31)* R5(AN23)* R16(P23.7)* R17(P23.6)* T4(AN30)* T5(AN22)* T6(AN15)* T7(AN12)* T8(AN6)* T9(AN4)* T12(P34.2)* T13(P34.4)* T14(P33.14)* T15(P32.5)* T17(P23.5)* T19(P22.12)* T20(P23.4)* U1(AN29/P40.14)* U2(AN28/P40.13)* U4(NC1)* U5(AN17/P40.10)* U6(AN14)* U7(AN9)* U8(AN7)* U9(AN3)* U11(P34.1)* U12(P34.3)* U13(P34.5)* U14(P33.15)* U15(P32.6)* U16(P32.7)* U20(P23.3)* V1(AN27/P40.3)* V2(AN26/P40.2)* V20(P23.2)* W1(AN25/P40.1)* W2(AN24/P40.0)* W3(AN19/P40.12)* W4(AN18/P40.11)* W5(AN16)* W6(AN13)* W7(AN11)* W8(AN8)* W9(AN2)* W10(P33.0)* W11(P33.2)* W15(P33.10)* W16(P33.12)* W17(P32.1/VGATE1P)* W18(P32.4)* Y1(NC1)* Y2(AN21)* Y3(AN20)* Y8(AN10)* Y9(AN5)* Y10(P33.1)* Y11(P33.3)* Y14(P33.9)* Y15(P33.11)* Y16(P33.13)* Y17(P32.0/VGATE1N)* Y18(P32.2)* Y19(P32.3)*; U6 7* 8*; U7 6(NC)*; U16 9(nFAULT)* 10(SNSOUT)* 11(SO)*; U17 8(3Y)* 9(3A)* 11(4Y)* 12(4A)*; U19 3(EN)*; U24 6(NC)*

## Notes on the sheets
sheet 1
- 1.3V电源_其余外设
- 屏幕接口
sheet 2
- 5.5V_dcdc
- 降压
- 5V电源
- 3.3V电源_摄像头＆主控
- 3.3V电源_其余外设
- 前无刷接线
- 后无刷接线
- 电池输入
- 直流电机输出
